# EasyEDA Pro project Access Control Core.eprj, board PCB4
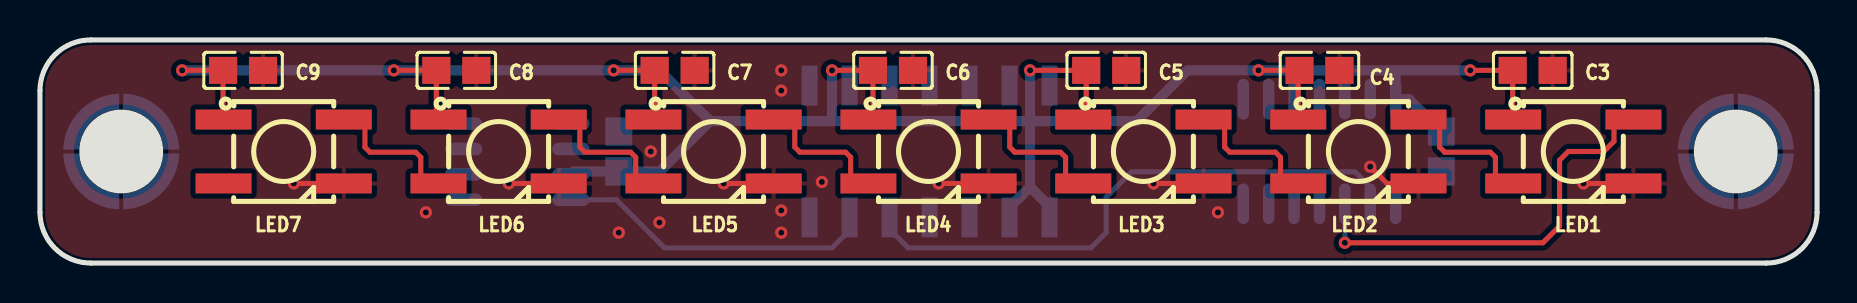
[diagram p15: board, top side]
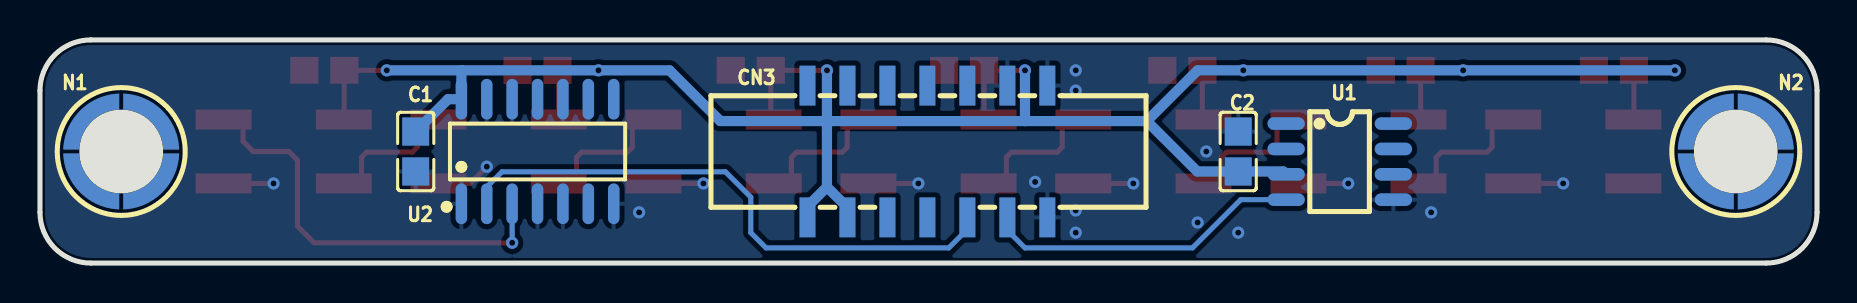
[diagram p16: board, bottom side, seen from below]

Outline 88.9 x 11.18 mm; copper layers: Top Layer, Bottom Layer. Coordinates in mm from the lower left corner of the outline.
Outline path: 0,8.64 0,2.54 arc(0.74,0.74) 2.54,0 86.36,0 arc(88.16,0.74) 88.9,2.54 88.9,8.64 arc(88.16,10.43) 86.36,11.18 2.54,11.18 arc(0.74,10.43) 0,8.64
Stack: Top Layer 0.035mm / Dielectric1 1.51mm FR4 er 4.5 / Bottom Layer 0.035mm

## Design rules (mm)
template: JLCPCB Capability(Two Layers Board)
spacing copperThickness1oz (default): track to track 0.102, other pairs 0.152 to 0.3
spacing copperThickness2oz: track to track 0.203, other pairs 0.152 to 0.3
track width copperThickness1oz (default): min 0.127, default 0.254, max 2.54
track width copperThickness2oz: min 0.203, default 0.254, max 2.54
differential pair differentialPair (default): width min 0.127, default 0.254, max 2.54; gap min 0.152, default 0.152
via viaSize (default): diameter min 0.5, default 0.61, max 10; hole min 0.3, default 0.305, max 6.3

## Placement (name value [footprint] x y rotation side)
C1  100nF  [C0805]  70.1 5.59 90 bottom
C2  100nF  [C0805]  28.96 5.59 270 bottom
C3  100nF  [C0805]  74.68 9.65 180 top
C4  100nF  [C0805]  64.01 9.65 180 top
C5  100nF  [C0805]  53.34 9.65 180 top
C6  100nF  [C0805]  42.67 9.65 180 top
C7  100nF  [C0805]  31.75 9.65 180 top
C8  100nF  [C0805]  20.83 9.65 180 top
C9  100nF  [C0805]  10.16 9.65 180 top
CN3  B-3002N14P-0110  [IDC-SMD_14P-P2.00_B-3002N14P-0110]  44.5 5.59 180 bottom
LED1  WS2812B-V5/W  [LED-SMD_4P-L5.0-W5.0-TL-1]  76.71 5.59 0 top
LED2  WS2812B-V5/W  [LED-SMD_4P-L5.0-W5.0-TL-1]  65.96 5.59 0 top
LED3  WS2812B-V5/W  [LED-SMD_4P-L5.0-W5.0-TL-1]  55.2 5.59 0 top
LED4  WS2812B-V5/W  [LED-SMD_4P-L5.0-W5.0-TL-1]  44.45 5.59 0 top
LED5  WS2812B-V5/W  [LED-SMD_4P-L5.0-W5.0-TL-1]  33.7 5.59 0 top
LED6  WS2812B-V5/W  [LED-SMD_4P-L5.0-W5.0-TL-1]  22.94 5.59 0 top
LED7  WS2812B-V5/W  [LED-SMD_4P-L5.0-W5.0-TL-1]  12.19 5.59 0 top
N1  SMTSO3040CTJ  [SMD-1_BD5.5-D4.0_H4.0]  84.84 5.59 180 bottom
N2  SMTSO3040CTJ  [SMD-1_BD5.5-D4.0_H4.0]  4.06 5.59 180 bottom
U1  DS18B20Z  [SOP-8_L4.9-W3.9-P1.27-LS6.0-BL]  23.88 5.08 270 bottom
U2  SN74AHCT125DR  [SOIC-14_L8.7-W3.9-P1.27-LS6.0-BL]  64.01 5.59 180 bottom

## Footprints (pads in the part's own frame, mm; a bottom-side part is the same pattern mirrored in y, then rotated)
C0805
  rect 1.41x1.35 smd: 1(-1,0) 2(1,0)
IDC-SMD_14P-P2.00_B-3002N14P-0110
  rect 0.8x2 smd: 1(-6,-3.3) 2(-6,3.3) 3(-4,-3.3) 4(-4,3.3) 5(-2,-3.3) 6(-2,3.3) 7(0,-3.3) 8(0,3.3) 9(2,-3.3) 10(2,3.3) 11(4,-3.3) 12(4,3.3) 13(6,-3.3) 14(6,3.3)
LED-SMD_4P-L5.0-W5.0-TL-1
  rect 2.8x1 smd: 1(-3.008,1.6) 2(-3.008,-1.6) 3(3.008,-1.6) 4(3.008,1.6)
SMD-1_BD5.5-D4.0_H4.0
  custom 2.8x2.8 smd: 1(-1.5,-1.5) 1(-1.5,1.5) 1(1.5,-1.5) 1(1.5,1.5)
SOIC-14_L8.7-W3.9-P1.27-LS6.0-BL
  oval 0.574x2.038 smd: 1(-3.81,-2.619) 2(-2.54,-2.619) 3(-1.27,-2.619) 4(0,-2.619) 5(1.27,-2.619) 6(2.54,-2.619) 7(3.81,-2.619) 8(3.81,2.619) 9(2.54,2.619) 10(1.27,2.619) 11(0,2.619) 12(-1.27,2.619) 13(-2.54,2.619) 14(-3.81,2.619)
SOP-8_L4.9-W3.9-P1.27-LS6.0-BL
  oval 0.63x1.865 smd: 1(-1.905,-2.683) 2(-0.635,-2.683) 3(0.635,-2.683) 4(1.905,-2.683) 5(1.905,2.683) 6(0.635,2.683) 7(-0.635,2.683) 8(-1.905,2.683)

## Nets
As in the schematic.

Pads without a net: CN3 2 4; LED7 2; N1 1; N2 1; U1 1 2 6 7 8; U2 6 8 11

## Via types
v1: diameter 0.61, hole 0.305, Top Layer to Bottom Layer, 25 vias

## Routing (per net, layer and track width the routed paths; a pad name or vN(x,y) marks a point on that pad's centre or on a via; arc(x,y) is an arc through that point)
+5V: length 123.9
  Top Layer w0.254: LED5.1 30.75,7.25 C7.2 v1(28.7,9.65) ; C3.2 73.68,7.21 LED1.1 ; v1(39.62,9.65) C6.2 41.67,7.42 LED4.1 ; 19.75,9.65 v1(17.7,9.65) ; C8.2 19.83,7.3 LED6.1 ; v1(49.53,9.65) C5.2 52.34,7.33 LED3.1 ; v1(7.11,9.65) C9.2 9.16,7.21 LED7.1 ; 73.6,9.65 v1(71.55,9.65) ; LED2.1 62.95,9.59 C4.2 v1(60.96,9.65)
  Bottom Layer w0.508: 39.62,7.11 33.53,7.11 ; 39.62,7.11 v1(39.62,9.65) ; 39.62,7.11 49.53,7.11 ; 33.53,7.11 31,4.59 C2.2 26.7,4.59 U1.3 ; 33.53,7.11 30.99,9.65 v1(28.7,9.65) v1(17.7,9.65) v1(7.11,9.65) ; CN3.1 50.5,2.84 49.53,3.81 ; 67.79,9.65 67.82,9.62 U2.14 68.48,8.21 C1.2 ; 67.79,9.65 v1(71.55,9.65) ; 67.79,9.65 v1(60.96,9.65) 57.4,9.65 54.86,7.11 49.53,7.11 ; 49.53,7.11 v1(49.53,9.65) ; 49.53,7.11 49.53,3.81 ; CN3.3 48.5,2.78 49.53,3.81
GND: length 17.8
  Top Layer w0.254: v1(66.55,4.83) 67.39,3.99 LED2.3 ; LED1.3 v1(77.22,3.99) ; LED5.3 v1(34.21,3.99) ; LED6.3 v1(23.45,3.99) ; LED4.3 v1(44.96,3.99) ; LED3.3 v1(55.71,3.99) ; LED7.3 v1(12.7,3.99)
  vias: v1(19.3,2.54) v1(28.96,1.52) v1(30.55,5.59) v1(30.99,2.03) v1(37.08,9.65) v1(37.08,8.64) v1(37.08,2.64) v1(37.08,1.52) v1(39.12,4.06) v1(58.93,2.54)
DIN: length 21.3
  Top Layer w0.254: LED1.4 79.07,7.19 78.74,6.86 78.74,6.1 78.23,5.59 76.45,5.59 76.02,5.15 76.02,1.85 75.18,1.02 v1(65.28,1.02)
  Bottom Layer w0.254: v1(65.28,1.02) U2.3
GPIO3: length 28.8
  Bottom Layer w0.254: U2.2 66.55,3.81 65.79,4.57 54.61,4.57 53.34,3.3 53.34,1.52 52.58,0.76 43.43,0.76 42.5,1.69 CN3.9
ONEWIRE: length 16
  Bottom Layer w0.254: U1.4 28.83,3.17 31.24,0.76 39.62,0.76 40.5,1.64 CN3.11
$1N1285: length 7.4
  Top Layer w0.254: LED1.2 72.89,3.99 72.81,4.06 72.81,5.3 72.56,5.55 70.27,5.55 70.02,5.81 70.02,6.86 69.69,7.19 LED2.4
$1N1388: length 7.4
  Top Layer w0.254: LED3.4 58.94,7.19 59.27,6.86 59.27,5.81 59.52,5.55 61.81,5.55 62.06,5.3 62.06,4.06 62.14,3.99 LED2.2
$1N1465: length 7.4
  Top Layer w0.254: LED3.2 51.38,3.99 51.31,4.06 51.31,5.3 51.05,5.55 48.77,5.55 48.51,5.81 48.51,6.86 48.18,7.19 LED4.4
$1N1542: length 7.4
  Top Layer w0.254: LED5.4 37.43,7.19 37.76,6.86 37.76,5.81 38.02,5.55 40.3,5.55 40.56,5.3 40.56,4.06 40.63,3.99 LED4.2
$1N1619: length 7.4
  Top Layer w0.254: LED6.4 26.68,7.19 27.01,6.86 27.01,5.81 27.26,5.55 29.55,5.55 29.8,5.3 29.8,4.06 29.88,3.99 LED5.2
$1N4210: length 7.4
  Top Layer w0.254: LED6.2 19.13,3.99 19.05,4.06 19.05,5.3 18.8,5.55 16.51,5.55 16.26,5.81 16.26,6.86 15.93,7.19 LED7.4

## Copper pours and planes (outline as drawn; the poured copper is in the pictures)
GND on Top Layer: -2.03,13.21 90.42,13.21 90.42,-3.05 -2.03,-3.05
GND on Bottom Layer: -1.02,13.21 90.42,13.21 90.42,-3.05 -1.02,-3.05
